# EasyEDA Pro project kuafu01_030内部老化方案_3.eprj (continued)
## Notes on the sheets (continued)
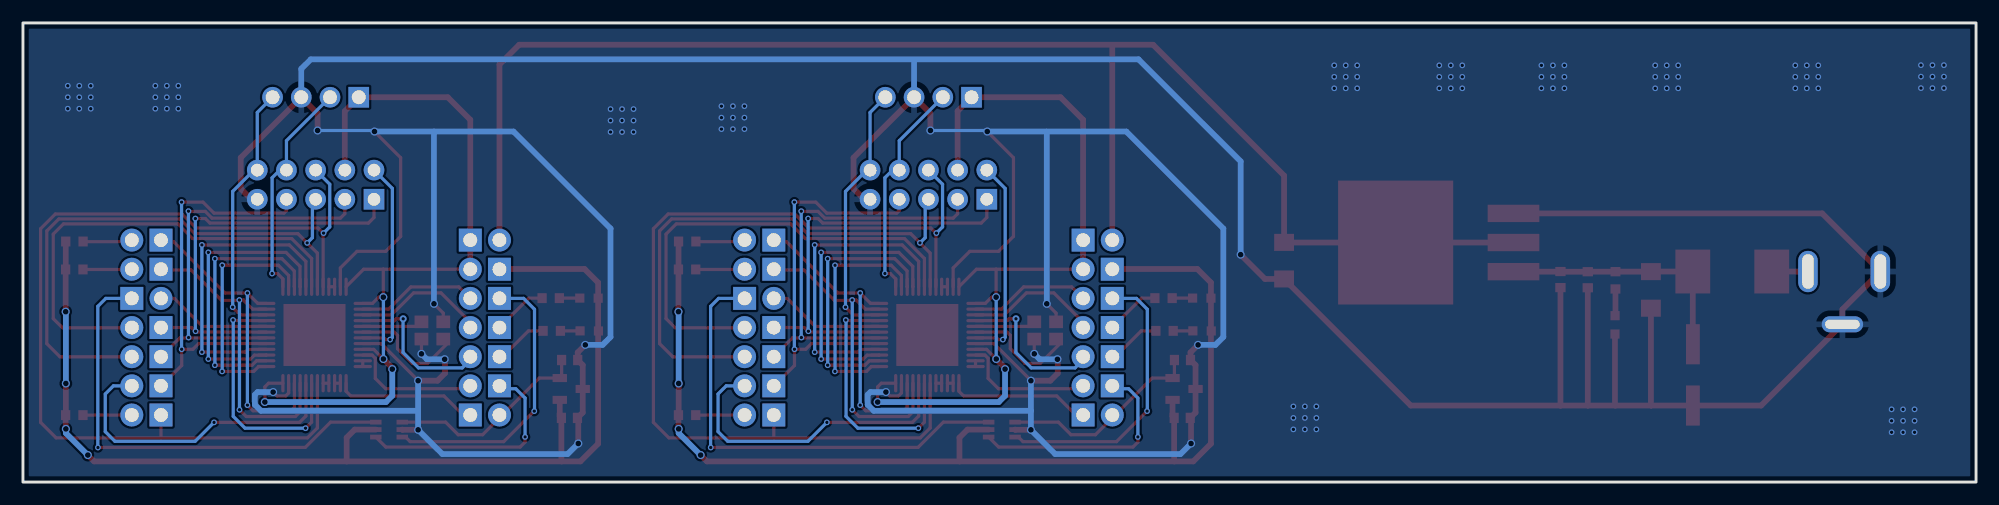
[diagram p3: board, bottom side, seen from below]

Outline 170 x 40 mm; copper layers: Top Layer, Bottom Layer. Coordinates in mm from the lower left corner of the outline.
Outline path: rectangle 0,40 170,0
Stack: Top Layer 0.035mm / Dielectric1 1.51mm FR4 er 4.5 / Bottom Layer 0.035mm

## Design rules (mm)
template: 用户自定义配置
spacing safeClearance (default): track to track 0.152, other pairs 0.152 to 0.3
track width trackWidth (default): min 0.127, default 0.254, max 2.54
differential pair differentialPair (default): width min 0.127, default 0.254, max 2.54; gap min 0.152, default 0.152
via viaSize (default): diameter min 0.5, default 0.61, max 10; hole min 0.3, default 0.305, max 6

## Placement (name value [footprint] x y rotation side)
C1  470nF  [C0603]  69.1 5.59 180 top
C1#2  -  [C0603]  122.44 5.59 180 top
C2  10uF  [C1206]  28.3 16.74 270 top
C3  10uF  [C1206]  60.23 19.29 90 top
C4  100uF  [CAP-SMD_BD6.3-L6.6-W6.6-LS7.6-FD-1]  24.64 9.34 270 top
C5  100nF  [C0603]  33.79 17.63 90 top
C6  100nF  [C0603]  69.07 10.63 0 top
C6#2  -  [C0603]  122.41 10.63 0 top
C7  100nF  [C0603]  36.17 17.64 90 top
CN1  DS254P-2X5-L0  [IDC-TH_10P-P2.54-V-R2-C5-S2.54]  91.19 25.91 0 top
CN1#2  -  [IDC-TH_10P-P2.54-V-R2-C5-S2.54]  144.53 25.91 0 top
CN2  XH-4A  [CONN-TH_4P-P2.50_XH-4A]  91.19 33.53 0 top
CN2#2  -  [CONN-TH_4P-P2.50_XH-4A]  144.53 33.53 0 top
D1  SS36-E3/57T  [SMC_L7.1-W6.2-LS8.1-R-RD]  21.22 18.34 180 top
DC1  HX DC005 QT  [DC-IN-TH_HANXIA_HX-DC005-QT]  11.48 16.04 0 top
H1  PZ254V-11-02P  [HDR-TH_2P-P2.54-V-M]  76.45 13.46 0 top
H1#2  -  [HDR-TH_2P-P2.54-V-M]  129.79 13.46 0 top
H2  PZ254V-11-02P  [HDR-TH_2P-P2.54-V-M]  76.45 10.92 0 top
H2#2  -  [HDR-TH_2P-P2.54-V-M]  129.79 10.92 0 top
H3  PZ254V-11-02P  [HDR-TH_2P-P2.54-V-M]  105.92 13.46 0 top
H3#2  -  [HDR-TH_2P-P2.54-V-M]  159.26 13.46 0 top
H4  PZ254V-11-02P  [HDR-TH_2P-P2.54-V-M]  105.92 10.92 0 top
H4#2  -  [HDR-TH_2P-P2.54-V-M]  159.26 10.92 0 top
H5  PZ254V-11-02P  [HDR-TH_2P-P2.54-V-M]  105.92 8.38 0 top
H5#2  -  [HDR-TH_2P-P2.54-V-M]  159.26 8.38 0 top
H6  PZ254V-11-02P  [HDR-TH_2P-P2.54-V-M]  105.92 16 180 top
H6#2  -  [HDR-TH_2P-P2.54-V-M]  159.26 16 180 top
H7  PZ254V-11-02P  [HDR-TH_2P-P2.54-V-M]  76.45 16 0 top
H7#2  -  [HDR-TH_2P-P2.54-V-M]  129.79 16 0 top
H8  PZ254V-11-02P  [HDR-TH_2P-P2.54-V-M]  76.45 8.38 0 top
H8#2  -  [HDR-TH_2P-P2.54-V-M]  129.79 8.38 0 top
H9  PZ254V-11-02P  [HDR-TH_2P-P2.54-V-M]  76.45 18.54 0 top
H9#2  -  [HDR-TH_2P-P2.54-V-M]  129.79 18.54 0 top
H10  PZ254V-11-02P  [HDR-TH_2P-P2.54-V-M]  76.45 21.08 180 top
H10#2  -  [HDR-TH_2P-P2.54-V-M]  129.79 21.08 180 top
H11  PZ254V-11-02P  [HDR-TH_2P-P2.54-V-M]  105.92 18.54 0 top
H11#2  -  [HDR-TH_2P-P2.54-V-M]  159.26 18.54 0 top
H12  PZ254V-11-02P  [HDR-TH_2P-P2.54-V-M]  105.92 21.08 0 top
H12#2  -  [HDR-TH_2P-P2.54-V-M]  159.26 21.08 0 top
H13  PZ254V-11-02P  [HDR-TH_2P-P2.54-V-M]  105.92 5.84 0 top
H13#2  -  [HDR-TH_2P-P2.54-V-M]  159.26 5.84 0 top
H14  PZ254V-11-02P  [HDR-TH_2P-P2.54-V-M]  76.45 5.84 180 top
H14#2  -  [HDR-TH_2P-P2.54-V-M]  129.79 5.84 180 top
LED1  NCD0603R1  [LED0603-RD_RED]  67.39 16.02 180 top
LED1#2  -  [LED0603-RD_RED]  120.73 16.02 180 top
LED2  19-217/GHC-YR1S2/3T  [LED0603-RD]  67.37 13.17 180 top
LED2#2  -  [LED0603-RD]  120.71 13.17 180 top
LED3  19-217/GHC-YR1S2/3T  [LED0603-RD]  31.42 13.7 90 top
R1  10K  [R0603]  70.72 16.02 180 top
R1#2  -  [R0603]  124.06 16.02 180 top
R2  10K  [R0603]  70.63 13.17 180 top
R2#2  -  [R0603]  123.97 13.17 180 top
R3  150Ω  [R0603]  112.19 5.83 0 top
R3#2  -  [R0603]  165.53 5.83 0 top
R4  0603WAF4701T5E/4.7KΩ  [R0603]  112.19 18.52 180 top
R4#2  -  [R0603]  165.53 18.52 180 top
R5  0603WAF4701T5E/4.7KΩ  [R0603]  112.18 20.96 0 top
R5#2  -  [R0603]  165.52 20.96 0 top
R6  10kΩ  [R0603]  31.38 17.58 90 top
U1  REF2920AIDBZR  [SOT-23-3_L2.9-W1.3-P1.90-LS2.4-BR]  68.94 8.11 0 top
U1#2  -  [SOT-23-3_L2.9-W1.3-P1.90-LS2.4-BR]  122.28 8.11 0 top
U2  BL1551B  [SC-70-6_L2.1-W1.3-P0.65-LS2.3-BR]  84.8 4.57 180 top
U2#2  -  [SC-70-6_L2.1-W1.3-P0.65-LS2.3-BR]  138.14 4.57 180 top
U6  PT32A030C8T7  [LQFP-48_L7.0-W7.0-P0.50-LS9.0-BL-EP5.4]  91.28 12.81 270 top
U6#2  -  [LQFP-48_L7.0-W7.0-P0.50-LS9.0-BL-EP5.4]  144.62 12.81 270 top
U7  AMS1086CM-5.0  [TO-263-3_L8.6-W10.2-P2.54-LS14.4-TL]  45.39 20.87 0 top
X1  25MHz  [OSC-SMD_4P-L2.5-W2.0-BL]  81.03 13.21 180 top
X1#2  -  [OSC-SMD_4P-L2.5-W2.0-BL]  134.37 13.21 180 top

## Footprints (pads in the part's own frame, mm; a bottom-side part is the same pattern mirrored in y, then rotated)
C0603
  rect 0.8x0.9 smd: 1(-0.7,0) 2(0.7,0)
C1206
  rect 1.485x1.728 smd: 1(-1.593,0) 2(1.593,0)
CAP-SMD_BD6.3-L6.6-W6.6-LS7.6-FD-1
  rect 3.5x1.2 smd: 1(-2.67,0) 2(2.67,0)
CONN-TH_4P-P2.50_XH-4A
  rect 1.8x1.8 hole 1.199: 1(-3.751,0)
  round 1.8 hole 1.199: 2(-1.25,0) 3(1.25,0) 4(3.751,0)
DC-IN-TH_HANXIA_HX-DC005-QT
  oval 3.6x1.4 hole 3x0.8: 2(0.15,-2.3)
  oval 1.7x3.6 hole 1x3: 3(-3.15,2.3) 4(3.15,2.3)
HDR-TH_2P-P2.54-V-M
  rect 2x2 hole 1.2: 1(-1.27,0)
  round 2 hole 1.2: 2(1.27,0)
IDC-TH_10P-P2.54-V-R2-C5-S2.54
  rect 1.8x1.8 hole 1.1: 1(-5.08,-1.27)
  round 1.8 hole 1.1: 2(-5.08,1.27) 3(-2.54,-1.27) 4(-2.54,1.27) 5(0,-1.27) 6(0,1.27) 7(2.54,-1.27) 8(2.54,1.27) 9(5.08,-1.27) 10(5.08,1.27)
LED0603-RD
  rect 0.8x0.8 smd: 1(-0.799,-0.004) 2(0.799,0.004)
LED0603-RD_RED
  rect 0.8x0.8 smd: 1(-0.799,-0.004) 2(0.799,0.004)
LQFP-48_L7.0-W7.0-P0.50-LS9.0-BL-EP5.4
  oval 0.28x1.6 smd: 1(-2.75,-4.2) 2(-2.25,-4.2) 3(-1.75,-4.2) 4(-1.25,-4.2) 5(-0.75,-4.2) 6(-0.25,-4.2) 7(0.25,-4.2) 8(0.75,-4.2) 9(1.25,-4.2) 10(1.75,-4.2) 11(2.25,-4.2) 12(2.75,-4.2) 25(2.75,4.2) 26(2.25,4.2) 27(1.75,4.2) 28(1.25,4.2) 29(0.75,4.2) 30(0.25,4.2) 31(-0.25,4.2) 32(-0.75,4.2) 33(-1.25,4.2) 34(-1.75,4.2) 35(-2.25,4.2) 36(-2.75,4.2)
  oval 1.6x0.28 smd: 13(4.2,-2.75) 14(4.2,-2.25) 15(4.2,-1.75) 16(4.2,-1.25) 17(4.2,-0.75) 18(4.2,-0.25) 19(4.2,0.25) 20(4.2,0.75) 21(4.2,1.25) 22(4.2,1.75) 23(4.2,2.25) 24(4.2,2.75) 37(-4.2,2.75) 38(-4.2,2.25) 39(-4.2,1.75) 40(-4.2,1.25) 41(-4.2,0.75) 42(-4.2,0.25) 43(-4.2,-0.25) 44(-4.2,-0.75) 45(-4.2,-1.25) 46(-4.2,-1.75) 47(-4.2,-2.25) 48(-4.2,-2.75)
  rect 5.4x5.4 smd: 49(0,0)
OSC-SMD_4P-L2.5-W2.0-BL
  rect 1.2x1.1 smd: 1(-0.95,-0.75) 2(0.95,-0.75) 3(0.95,0.75) 4(-0.95,0.75)
R0603
  rect 0.806x0.864 smd: 1(-0.753,0) 2(0.753,0)
SC-70-6_L2.1-W1.3-P0.65-LS2.3-BR
  rect 1x0.42 smd: 1(1.15,-0.65) 2(1.15,0) 3(1.15,0.65) 4(-1.15,0.65) 5(-1.15,0) 6(-1.15,-0.65)
SMC_L7.1-W6.2-LS8.1-R-RD
  rect 3.03x3.82 smd: 1(3.435,0) 2(-3.435,0)
SOT-23-3_L2.9-W1.3-P1.90-LS2.4-BR
  rect 1.25x0.7 smd: 1(1,-0.95) 2(1,0.95) 3(-1,0)
TO-263-3_L8.6-W10.2-P2.54-LS14.4-TL
  rect 4.5x1.511 smd: 1(-5.128,2.54) 2(-5.128,0) 3(-5.128,-2.54)
  rect 10.02x10.8 smd: 4(5.129,0)

## Nets
2.048V: C6.2 C6#2.2 H14.2 H14#2.2 U1.2 U1#2.2 U2.1 U2#2.1
6.5V: C2.1 C4.1 C5.2 C7.2 D1.2 R6.2 U7.3
GND: C1.2 C1#2.2 C2.2 C3.1 C4.2 C5.1 C6.1 C6#2.1 C7.1 CN1.9 CN1#2.9 CN2.3 CN2#2.3 DC1.2 DC1.3 LED3.1 U1.3 U1#2.3 U2.2 U2#2.2 U6.8 U6.23 U6.47 U6#2.8 U6#2.23 U6#2.47 U7.1 X1.2 X1.4 X1#2.2 X1#2.4
LDO_5V: C3.2 H10.2 H10#2.2 U7.2 U7.4
MCU_5V: CN1.4 CN1#2.4 CN2.1 CN2#2.1 H9.2 H9#2.2 H10.1 H10#2.1 U6.1 U6.9 U6.24 U6.48 U6#2.1 U6#2.9 U6#2.24 U6#2.48
PA0/OPA1_P/CMP1_P: H8.2 H8#2.2 U6.10 U6#2.10
PA1/OPA1_N: U6.11 U6.12 U6#2.11 U6#2.12
PA3/OPA0_P: H14.1 H14#2.1 U6.13 U6#2.13
PA4/OPA0_N: U6.14 U6.15 U6#2.14 U6#2.15
PA6/SET_ADC_ETR: U6.16 U6.17 U6#2.16 U6#2.17
PA8/TIM1_CH1/CMP2_OUT/TSTROBE: CN1.7 CN1#2.7 H5.1 H5#2.1 U6.29 U6#2.29
PA9/UART1_TX/CMP0_OUT/TDI: CN1.3 CN1#2.3 H4.1 H4#2.1 U6.30 U6#2.30
PA10/UART1_RX/CMP1_OUT/TDO: CN1.1 CN1#2.1 H3.1 H3#2.1 U6.31 U6#2.31
PA11/ENB1: H6.2 H6#2.2 U6.32 U6#2.32
PA12/TIM1_ETR: U6.19 U6.33 U6#2.19 U6#2.33
PA13/SWDIO/TAI: CN1.10 CN1#2.10 CN2.4 CN2#2.4 U6.34 U6#2.34
PA14/SWCLK/TAO: CN1.8 CN1#2.8 CN2.2 CN2#2.2 U6.37 U6#2.37
PA15/SPI1_CS: U6.25 U6.38 U6#2.25 U6#2.38
PB0/GET_BEEP: CN1.6 CN1#2.6 H13.1 H13#2.1 U6.18 U6.44 U6#2.18 U6#2.44
PB6/UART0_TX/GET_MCP1_OUT: H3.2 H3#2.2 U6.42 U6#2.42
PB7/UART0_RX/TCK: CN1.5 CN1#2.5 H4.2 H4#2.2 U6.43 U6#2.43
PB8/TIM6_CH1: U6.45 U6.46 U6#2.45 U6#2.46
PB10/I2C1_SCL/CMP0_P1: H11.1 H11#2.1 U6.21 U6.35 U6#2.21 U6#2.35
PB11/I2C1_SDA: H12.1 H12#2.1 U6.22 U6.36 U6#2.22 U6#2.36
PB13/SPI0_SCK: U6.26 U6.39 U6#2.26 U6#2.39
PB14/SPI0_MISO: U6.27 U6.40 U6#2.27 U6#2.40
PB15/SPI0_MOSI/SET_CMP2_P0: U6.28 U6.41 U6#2.28 U6#2.41
PC13/SET_CMP1_P: H7.2 H7#2.2 U6.2 U6#2.2
PC14/LED_RED: H1.2 H1#2.2 U6.3 U6#2.3
PC15/LED_GREEN: H2.2 H2#2.2 U6.4 U6#2.4
PERIPHERAL_5V: C1.1 C1#2.1 H9.1 H9#2.1 LED1.2 LED1#2.2 LED2.2 LED2#2.2 R3.2 R3#2.2 R4.1 R4#2.1 R5.2 R5#2.2 U1.1 U1#2.1 U2.5 U2#2.5
PF0/OSC_IN: U6.5 U6#2.5 X1.1 X1#2.1
PF1/OSC_OUT: U6.6 U6#2.6 X1.3 X1#2.3
PF2/TIM5_CH1/GET_CMP2_OUT: H5.2 H5#2.2 U6.20 U6#2.20
RSTN: CN1.2 CN1#2.2 U6.7 U6#2.7
$3N9153: D1.1 DC1.4
$3N9301: LED3.2 R6.1
$4N6329: LED2.1 LED2#2.1 R2.2 R2#2.2
$4N6330: LED1.1 LED1#2.1 R1.2 R1#2.2
$4N10186: H7.1 H7#2.1 U2.3 U2#2.3
$4N10193: H6.1 H6#2.1 U2.6 U2#2.6
$4N10258: H2.1 H2#2.1 R2.1 R2#2.1
$4N10262: H1.1 H1#2.1 R1.1 R1#2.1
$4N16114: H8.1 H8#2.1 U2.4 U2#2.4
$4N17047: H11.2 H11#2.2 R4.2 R4#2.2
$4N17074: H12.2 H12#2.2 R5.1 R5#2.1
$4N17158: H13.2 H13#2.2 R3.1 R3#2.1

Pads without a net: U6 49; U6#2 49

## Via types
v1: diameter 0.5, hole 0.3, Top Layer to Bottom Layer, 166 vias
v2: diameter 0.7, hole 0.5, Top Layer to Bottom Layer, 37 vias
v3: diameter 0.61, hole 0.305, Top Layer to Bottom Layer, 2 vias

## Routing (per net, layer and track width the routed paths; a pad name or vN(x,y) marks a point on that pad's centre or on a via; arc(x,y) is an arc through that point)
2.048V: length 35.7
  Top Layer w0.28: C6#2.2 123.11,9.22 U1#2.2 125.05,9.06 129.99,4.12 132.12,4.12 133.22,5.22 U2#2.1 ; U2.1 79.88,5.22 78.78,4.12 76.65,4.12 71.71,9.06 U1.2 69.77,9.22 C6.2
6.5V: length 22
  Top Layer w0.5: U7.3 36.19,18.33 C7.2 36.15,18.33 C5.2 33.79,18.33 R6.2 31.38,18.33 C2.1 28.29,18.34 D1.2 24.65,12.02 C4.1
GND: length 544.7
  Top Layer w0.28: v2(80.89,15.53) 80.08,14.72 X1.2 ; X1#2.2 133.42,14.72 v2(134.23,15.53) ; U6#2.47 142.38,18.65 140.93,20.1 138.43,20.1 137.13,21.4 137.13,28.26 v2(139.41,30.54) ; U6.47 89.03,18.65 87.59,20.1 85.09,20.1 83.79,21.4 83.79,28.26 v2(86.07,30.54) ; 87.09,12.06 85.48,12.06 82.27,8.85 v2(82.27,8.83) ; U6#2.23 146.87,7.76 147.14,7.5 147.89,7.5 v2(148.23,7.84) ; v2(94.89,7.84) 94.55,7.5 93.8,7.5 93.53,7.76 U6.23 ; X1#2.4 v2(135.32,11.17) ; 140.43,12.06 138.82,12.06 135.61,8.85 v2(135.61,8.83) ; X1.4 v2(81.98,11.17)
  Top Layer w0.5: C5.1 33.79,6.68 33.78,6.67 ; v2(67.72,11.95) 68.37,11.29 C6.1 67.94,10.19 U1.3 67.94,6.05 C1.2 68.33,5.52 v2(68.33,3.36) ; U7.1 13.39,23.41 8.33,18.34 11.63,15.04 DC1.2 18.71,6.67 C4.2 28.28,6.67 ; LED3.1 31.43,6.7 31.4,6.67 ; C7.1 36.17,6.67 36.17,6.67 ; CN1.9 96.78,24.64 97.71,25.56 97.71,28.26 CN2.3 91.02,32.11 v2(91.02,30.63) ; v2(135.61,4.55) 136.97,4.55 U2#2.2 ; v2(82.27,8.83) 80.58,8.83 79.93,9.48 79.93,10.67 v2(79.96,10.7) ; 28.28,6.67 28.3,6.68 C2.2 ; 28.28,6.67 31.4,6.67 ; 36.17,6.67 49.2,6.67 C3.1 61.89,17.7 v2(64.01,19.81) ; 36.17,6.67 33.78,6.67 ; v2(133.3,10.7) 133.27,10.67 133.27,9.48 133.92,8.83 v2(135.61,8.83) ; 31.4,6.67 33.78,6.67 ; v2(82.27,4.55) 83.63,4.55 U2.2 ; v2(121.06,11.95) 121.71,11.29 C6#2.1 121.28,10.19 U1#2.3 121.28,6.05 C1#2.2 121.67,5.52 v2(121.67,3.36) ; v2(144.36,30.63) 144.36,32.11 CN2#2.3 151.05,28.26 151.05,25.56 150.12,24.64 CN1#2.9
  Bottom Layer w0.28: v2(139.41,30.54) 139.5,30.63 v2(144.36,30.63) ; v2(91.02,30.63) 86.16,30.63 v2(86.07,30.54)
  Bottom Layer w0.5: v2(135.61,8.83) 135.61,6.21 ; 135.61,6.21 149.28,6.21 149.81,6.74 149.81,7.6 149.58,7.84 v2(148.23,7.84) ; 135.61,6.21 v2(135.61,4.55) 133.5,2.44 122.59,2.44 v2(121.67,3.36) ; 82.27,6.21 95.94,6.21 96.47,6.74 96.47,7.6 96.24,7.84 v2(94.89,7.84) ; 82.27,6.21 v2(82.27,4.55) 80.16,2.44 69.25,2.44 v2(68.33,3.36) ; 82.27,6.21 v2(82.27,8.83) ; v2(64.01,19.81) 64.01,27.94 72.9,36.83 144.95,36.83 145.78,36 CN2#2.3 ; CN2.3 92.44,36.78 ; v2(80.89,15.53) 80.89,30.54 ; v2(81.98,11.17) 81.51,10.7 v2(79.96,10.7) ; v2(67.72,11.95) 66.21,11.95 65.52,12.64 65.52,22.09 73.97,30.54 v2(86.07,30.54) ; v2(121.06,11.95) 119.55,11.95 118.86,12.64 118.86,22.09 127.31,30.54 v2(139.41,30.54) ; v2(135.32,11.17) 134.85,10.7 v2(133.3,10.7) ; v2(134.23,15.53) 134.23,30.54
  vias: v1(2.79,36.32) v1(2.79,35.32) v1(2.79,34.32) v1(3.79,36.32) v1(3.79,35.32) v1(3.79,34.32) v1(4.79,36.32) v1(4.79,35.32) v1(4.79,34.32) v1(5.35,6.33) v1(5.35,5.33) v1(5.35,4.33) v1(6.35,6.33) v1(6.35,5.33) v1(6.35,4.33) v1(7.35,6.33) v1(7.35,5.33) v1(7.35,4.33) v1(13.73,36.31) v1(13.73,35.31) v1(13.73,34.31) v1(14.73,36.31) v1(14.73,35.31) v1(14.73,34.31) v1(15.73,36.31) v1(15.73,35.31) v1(15.73,34.31) v1(25.92,36.31) v1(25.92,35.31) v1(25.92,34.31) v1(26.92,36.31) v1(26.92,35.31) v1(26.92,34.31) v1(27.92,36.31) v1(27.92,35.31) v1(27.92,34.31) v1(35.83,36.31) v1(35.83,35.31) v1(35.83,34.31) v1(36.83,36.31) v1(36.83,35.31) v1(36.83,34.31) v1(37.83,36.31) v1(37.83,35.31) v1(37.83,34.31) v1(44.72,36.31) v1(44.72,35.31) v1(44.72,34.31) v1(45.72,36.31) v1(45.72,35.31) v1(45.72,34.31) v1(46.72,36.31) v1(46.72,35.31) v1(46.72,34.31) v1(53.86,36.31) v1(53.86,35.31) v1(53.86,34.31) v1(54.86,36.31) v1(54.86,35.31) v1(54.86,34.31) v1(55.86,36.31) v1(55.86,35.31) v1(55.86,34.31) v1(57.42,6.59) v1(57.42,5.59) v1(57.42,4.59) v1(58.42,6.59) v1(58.42,5.59) v1(58.42,4.59) v1(59.42,6.59) v1(59.42,5.59) v1(59.42,4.59) v1(107.2,32.75) v1(107.2,31.75) v1(107.2,30.75) v1(108.2,32.75) v1(108.2,31.75) v1(108.2,30.75) v1(109.2,32.75) v1(109.2,31.75) v1(109.2,30.75) v1(116.86,32.5) v1(116.86,31.5) v1(116.86,30.5) v1(117.86,32.5) v1(117.86,31.5) v1(117.86,30.5) v1(118.86,32.5) v1(118.86,31.5) v1(118.86,30.5) v1(156.48,34.53) v1(156.48,33.53) v1(156.48,32.53) v1(157.48,34.53) v1(157.48,33.53) v1(157.48,32.53) v1(158.48,34.53) v1(158.48,33.53) v1(158.48,32.53) v1(164.1,34.53) v1(164.1,33.53) v1(164.1,32.53) v1(165.1,34.53) v1(165.1,33.53) v1(165.1,32.53) v1(166.1,34.53) v1(166.1,33.53) v1(166.1,32.53)
LDO_5V: length 131.7
  Top Layer w0.5: H10.2 75.18,37.92 ; H10#2.2 128.52,36.38 126.81,38.1 71.63,38.1 60.23,26.7 C3.2 60.22,20.87 U7.4 U7.2
MCU_5V: length 143.4
  Top Layer w0.28: 138.63,18.54 138.64,18.54 v2(138.64,16.11) 139.03,16.11 139.58,15.56 140.43,15.56 ; 138.63,18.54 H9#2.2 ; 138.63,18.54 140.35,18.54 U6#2.48 ; U6.24 95.28,8.61 95.61,8.29 v2(95.61,6.97) ; 87.09,15.56 86.24,15.56 85.69,16.11 v2(85.3,16.11) 85.3,18.54 85.29,18.54 ; U6.48 87.01,18.54 85.29,18.54 ; v2(85.29,10.72) 86.13,11.56 87.09,11.56 ; v2(148.95,6.97) 148.95,8.29 148.62,8.61 U6#2.24 ; 85.29,18.54 H9.2 ; 140.43,11.56 139.47,11.56 v2(138.63,10.72)
  Top Layer w0.5: CN1#2.4 141.99,32.32 CN2#2.1 133.03,33.53 131.06,31.57 H10#2.1 H9#2.2 ; H9.2 H10.1 77.72,31.57 79.69,33.53 CN2.1 88.65,32.32 CN1.4 ; v2(84.52,9.84) 84.52,9.95 v2(85.29,10.72) ; v2(138.63,10.72) 137.86,9.95 v2(137.86,9.84)
  Bottom Layer w0.28: v2(85.29,10.72) 85.29,16.1 v2(85.3,16.11) ; v2(138.64,16.11) 138.63,16.1 v2(138.63,10.72)
  Bottom Layer w0.5: v2(148.95,6.97) 138.41,6.97 137.86,7.52 v2(137.86,9.84) ; v2(84.52,9.84) 84.52,7.52 85.07,6.97 v2(95.61,6.97)
PA0/OPA1_P/CMP1_P: length 23.2
  Top Layer w0.28: 131.06,8.13 138.43,8.13 139.33,9.03 139.33,10.78 139.61,11.06 140.43,11.06 ; 87.09,11.06 86.27,11.06 85.99,10.78 85.99,9.03 85.09,8.13 77.72,8.13
PA1/OPA1_N: length 1
  Top Layer w0.28: 140.43,10.56 140.43,10.06 ; 87.09,10.56 87.09,10.06
PA3/OPA0_P: length 25
  Top Layer w0.28: U6.13 88.53,7.91 88.13,7.5 80.02,7.5 78.1,5.59 77.72,5.59 ; 131.06,5.59 131.44,5.59 133.36,7.5 141.47,7.5 141.87,7.91 U6#2.13
PA4/OPA0_N: length 1
  Top Layer w0.28: U6.14 U6.15 ; U6#2.14 U6#2.15
PA6/SET_ADC_ETR: length 1
  Top Layer w0.28: U6#2.16 U6#2.17 ; U6.16 U6.17
PA8/TIM1_CH1/CMP2_OUT/TSTROBE: length 69.9
  Top Layer w0.28: v1(156.2,24.39) 154.33,24.39 153.37,23.43 147.28,23.43 147.07,23.65 CN1#2.7 ; v1(102.86,24.39) 100.99,24.39 100.03,23.43 93.94,23.43 93.73,23.65 CN1.7 ; H5#2.1 157.96,8.38 156.19,10.15 v1(156.19,11.57) 155.21,11.57 154.71,12.07 148.83,12.07 U6#2.29 ; U6.29 95.49,12.07 101.37,12.07 101.87,11.57 v1(102.85,11.57) 102.85,10.15 104.62,8.38 H5.1
  Bottom Layer w0.28: v1(102.85,11.57) 102.86,11.58 v1(102.86,24.39) ; v1(156.2,24.39) 156.2,11.58 v1(156.19,11.57)
PA9/UART1_TX/CMP0_OUT/TDI: length 72.3
  Top Layer w0.28: U6.30 103.01,12.56 H4.1 ; CN1#2.3 141.99,23.38 142.37,22.99 153.55,22.99 154.14,23.58 155.58,23.58 v1(155.6,23.6) ; H4#2.1 156.35,12.56 U6#2.30 ; CN1.3 88.65,23.38 89.03,22.99 100.21,22.99 100.8,23.58 102.24,23.58 v1(102.26,23.6)
  Bottom Layer w0.28: v1(102.26,23.6) 102.26,12.6 v1(102.25,12.59) ; v1(155.59,12.59) 155.6,12.6 v1(155.6,23.6)
PA10/UART1_RX/CMP1_OUT/TDO: length 73.3
  Top Layer w0.28: CN1.1 86.11,23.05 86.59,22.56 100.39,22.56 100.79,22.96 v1(101.66,22.96) ; CN1#2.1 139.45,23.05 139.93,22.56 153.73,22.56 154.13,22.96 v1(155,22.96) ; U6.31 101.6,13.06 102,13.46 H3.1 ; H3#2.1 155.34,13.46 154.94,13.06 U6#2.31
  Bottom Layer w0.28: v1(101.66,22.96) 101.66,13.16 v1(101.64,13.14) ; v1(155,22.96) 155,13.16 v1(154.98,13.14)
PA11/ENB1: length 20.3
  Top Layer w0.28: H6.2 103.49,16 101.05,13.56 U6.32 ; H6#2.2 156.83,16 154.39,13.56 U6#2.32
PA12/TIM1_ETR: length 44.4
  Top Layer w0.28: 91.54,8.61 91.54,5.22 v1(92.07,4.69) ; 144.88,8.61 144.88,5.22 v1(145.41,4.69) ; v1(151.72,14.12) 151.66,14.06 U6#2.33 ; U6.33 98.32,14.06 v1(98.38,14.12)
  Bottom Layer w0.28: v1(92.07,4.69) 97.33,4.69 98.36,5.72 98.36,14.1 v1(98.38,14.12) ; v1(145.41,4.69) 150.67,4.69 151.7,5.72 151.7,14.1 v1(151.72,14.12)
PA13/SWDIO/TAI: length 46.4
  Top Layer w0.28: v1(151.75,15.24) 151.75,15.23 151.08,14.56 U6#2.34 ; v1(98.41,15.24) 98.41,15.23 97.74,14.56 U6.34
  Bottom Layer w0.28: CN2.4 96.27,32.2 CN1.10 96.41,27.32 98.41,25.32 v1(98.41,15.24) ; CN2#2.4 149.61,32.2 CN1#2.10 149.75,27.32 151.75,25.32 v1(151.75,15.24)
PA14/SWCLK/TAO: length 39.2
  Top Layer w0.28: v1(94.98,18.17) 94.51,18.17 94.03,17.7 U6.37 ; U6#2.37 147.37,17.7 147.85,18.17 v1(148.32,18.17)
  Bottom Layer w0.28: v1(94.98,18.17) 94.98,26.51 94.31,27.18 CN1.8 93.73,29.74 CN2.2 ; v1(148.32,18.17) 148.32,26.51 147.65,27.18 CN1#2.8 147.07,29.74 CN2#2.2
PA15/SPI1_CS: length 40.8
  Top Layer w0.28: 146.88,17.02 146.88,18 147.77,18.89 v1(152.66,18.89) ; U6#2.25 149.49,10.06 149.92,9.64 v1(152.67,9.64) ; v1(99.32,18.89) 94.43,18.89 93.54,18 93.54,17.02 ; v1(99.33,9.64) 96.58,9.64 96.15,10.06 U6.25
  Bottom Layer w0.28: v1(152.66,18.89) 152.66,9.65 v1(152.67,9.64) ; v1(99.33,9.64) 99.32,9.65 v1(99.32,18.89)
PB0/GET_BEEP: length 169.1
  Top Layer w0.28: 104.63,3.85 91.9,3.85 91.03,4.71 U6.18 ; 104.63,3.85 104.65,3.86 H13.1 ; 104.63,3.85 113.78,3.85 115.13,5.2 115.13,22.07 113.84,23.36 102.82,23.36 101.59,22.13 90.98,22.13 90.53,21.69 ; 143.87,21.69 144.32,22.13 154.93,22.13 156.16,23.36 167.18,23.36 168.47,22.07 168.47,5.2 167.12,3.85 157.97,3.85 ; 143.87,21.69 143.83,21.69 ; 143.87,21.69 U6#2.44 ; 90.53,21.69 U6.44 ; 90.53,21.69 90.49,21.69 ; 157.97,3.85 157.99,3.86 H13#2.1 ; 157.97,3.85 145.24,3.85 144.38,4.71 U6#2.18
  Bottom Layer w0.28: CN1#2.6 143.3,25.95 143.3,22.23 v1(143.84,21.69) ; v1(90.5,21.69) 89.96,22.23 89.96,25.95 CN1.6
PB6/UART0_TX/GET_MCP1_OUT: length 82.2
  Top Layer w0.28: H3.2 107.21,13.44 113.23,13.44 114.03,14.24 114.03,21.6 113.13,22.49 103.18,22.49 101.89,21.21 93.27,21.21 91.53,19.48 U6.42 ; H3#2.2 160.55,13.44 166.57,13.44 167.37,14.24 167.37,21.6 166.47,22.49 156.52,22.49 155.23,21.21 146.61,21.21 144.87,19.48 U6#2.42
PB7/UART0_RX/TCK: length 99.9
  Top Layer w0.28: U6#2.43 144.38,19.95 v1(145.26,20.84) 146.07,21.64 155.06,21.64 156.34,22.92 166.88,22.92 167.93,21.88 167.93,12.06 166.78,10.91 160.54,10.91 H4#2.2 ; H4.2 107.2,10.91 113.44,10.91 114.59,12.06 114.59,21.88 113.54,22.92 103,22.92 101.72,21.64 92.73,21.64 v1(91.92,20.84) 91.03,19.95 U6.43
  Bottom Layer w0.28: v1(91.92,20.84) 91.47,21.29 91.47,24.36 CN1.5 ; v1(145.26,20.84) 144.81,21.29 144.81,24.36 CN1#2.5
PB8/TIM6_CH1: length 1
  Top Layer w0.28: U6.45 U6.46 ; U6#2.45 U6#2.46
PB10/I2C1_SCL/CMP0_P1: length 56.7
  Top Layer w0.28: U6.35 96.67,15.06 97.47,15.86 v1(97.83,15.86) 97.85,15.83 99.38,15.83 102.03,18.48 104.59,18.48 104.63,18.52 ; U6.21 92.53,6.12 92.95,5.71 97.23,5.71 v1(97.82,6.3) ; U6#2.21 145.87,6.12 146.29,5.71 150.57,5.71 v1(151.16,6.3) ; U6#2.35 150.01,15.06 150.81,15.86 v1(151.17,15.86) 151.19,15.83 152.72,15.83 155.37,18.48 157.93,18.48 157.97,18.52
  Bottom Layer w0.28: v1(151.16,6.3) 151.16,15.85 v1(151.17,15.86) ; v1(97.83,15.86) 97.82,15.85 v1(97.82,6.3)
PB11/I2C1_SDA: length 55.3
  Top Layer w0.28: U6.36 96.22,15.56 v1(97.13,16.47) 99.07,16.47 103.55,20.95 104.63,20.95 ; U6#2.36 149.56,15.56 v1(150.47,16.47) 152.41,16.47 156.89,20.95 157.97,20.95 ; v1(97.13,6.7) 96.64,6.21 93.33,6.21 93.03,6.5 U6.22 ; U6#2.22 146.38,6.5 146.67,6.21 149.98,6.21 v1(150.47,6.7)
  Bottom Layer w0.28: v1(150.47,6.7) v1(150.47,16.47) ; v1(97.13,6.7) v1(97.13,16.47)
PB13/SPI0_SCK: length 45.3
  Top Layer w0.28: U6.26 96.33,10.56 96.71,10.18 99.95,10.18 v1(99.96,10.18) ; U6#2.26 149.67,10.56 150.05,10.18 153.29,10.18 v1(153.3,10.18) ; U6#2.39 146.39,17.03 146.39,18.39 147.46,19.46 v1(153.3,19.46) ; U6.39 93.05,17.03 93.05,18.39 94.12,19.46 v1(99.96,19.46)
  Bottom Layer w0.28: v1(153.3,10.18) v1(153.3,19.46) ; v1(99.96,10.18) v1(99.96,19.46)
PB14/SPI0_MISO: length 49.5
  Top Layer w0.28: U6.40 92.55,17.03 92.55,18.79 93.77,20.01 v1(100.53,20.01) ; U6.27 95.49,11.06 96.52,11.06 96.85,10.72 100.52,10.72 v1(100.53,10.72) ; U6#2.27 148.83,11.06 149.86,11.06 150.19,10.72 153.86,10.72 v1(153.87,10.72) ; U6#2.40 145.89,17.03 145.89,18.79 147.11,20.01 v1(153.87,20.01)
  Bottom Layer w0.28: v1(153.87,10.72) v1(153.87,20.01) ; v1(100.53,10.72) v1(100.53,20.01)
PB15/SPI0_MOSI/SET_CMP2_P0: length 53.8
  Top Layer w0.28: v1(101.09,11.32) 97.34,11.32 97.1,11.56 U6.28 ; v1(154.43,20.66) 146.82,20.66 145.38,19.22 145.38,17.02 ; v1(101.09,20.66) 93.48,20.66 92.04,19.22 92.04,17.02 ; U6#2.28 150.44,11.56 150.68,11.32 v1(154.43,11.32)
  Bottom Layer w0.28: v1(101.09,20.66) v1(101.09,11.32) ; v1(154.43,20.66) v1(154.43,11.32)
PC13/SET_CMP1_P: length 21.2
  Top Layer w0.28: 87.09,15.06 84.84,15.06 82.9,17 78.72,17 H7.2 ; 140.43,15.06 138.18,15.06 136.24,17 132.06,17 H7#2.2
PC14/LED_RED: length 23.4
  Top Layer w0.28: H1.2 77.72,13.93 80.27,16.48 82.66,16.48 84.58,14.56 87.09,14.56 ; H1#2.2 131.06,13.93 133.61,16.48 136,16.48 137.92,14.56 140.43,14.56
PC15/LED_GREEN: length 26.4
  Top Layer w0.28: v3(83.57,14.22) 84.17,14.22 84.33,14.06 87.09,14.06 ; 140.43,14.06 137.67,14.06 137.51,14.22 v3(136.91,14.22)
  Bottom Layer w0.28: v3(83.57,14.22) 83.58,14.21 83.58,11.29 82.23,9.95 78.42,9.95 77.73,10.64 ; v3(136.91,14.22) 136.92,14.21 136.92,11.29 135.57,9.95 131.76,9.95 131.07,10.64
PERIPHERAL_5V: length 196.4
  Top Layer w0.5: v2(112.95,14.84) R4.1 112.94,18.53 R5.2 ; U2#2.5 141.13,4.57 141.83,3.87 141.83,1.82 141.81,1.8 ; v2(166.27,8.59) 166.27,5.85 R3#2.2 166.29,4.65 v2(166.27,4.63) ; v2(164.36,2.35) 163.81,1.8 141.81,1.8 ; v2(166.29,14.84) R4#2.1 166.28,18.53 R5#2.2 ; 69.78,1.8 69.8,1.82 C1.1 69.94,5.73 U1.1 ; 69.78,1.8 68.14,1.8 66.6,3.34 66.6,13.14 LED2.2 66.59,13.19 LED1.2 66.59,17.38 67.78,18.56 75.17,18.56 H9.1 ; 69.78,1.8 88.47,1.8 ; U2.5 87.79,4.57 88.49,3.87 88.49,1.82 88.47,1.8 ; 141.81,1.8 123.12,1.8 ; U1#2.1 123.28,5.73 C1#2.1 123.14,1.82 123.12,1.8 ; 88.47,1.8 110.47,1.8 v2(111.02,2.35) ; H9#2.1 128.51,18.56 121.12,18.56 119.93,17.38 LED1#2.2 119.93,13.19 LED2#2.2 119.94,13.14 119.94,3.34 121.48,1.8 123.12,1.8 ; v2(112.93,4.63) 112.95,4.65 R3.2 112.93,5.85 v2(112.93,8.59)
  Bottom Layer w0.5: v2(112.95,14.84) 112.93,14.82 v2(112.93,8.59) ; v2(166.27,8.59) 166.27,14.82 v2(166.29,14.84) ; v2(166.27,4.63) 166.27,4.26 v2(164.36,2.35) ; v2(111.02,2.35) 112.93,4.26 v2(112.93,4.63)
PF0/OSC_IN: length 10.5
  Top Layer w0.28: 140.43,13.56 135.71,13.56 X1#2.1 ; 87.09,13.56 82.37,13.56 X1.1
PF1/OSC_OUT: length 19.9
  Top Layer w0.28: 140.43,13.06 137.68,13.06 137.4,12.78 137.4,11.61 136.11,10.33 134.8,10.33 133.05,12.09 ; 79.71,12.09 81.46,10.33 82.77,10.33 84.06,11.61 84.06,12.78 84.34,13.06 87.09,13.06
PF2/TIM5_CH1/GET_CMP2_OUT: length 54.9
  Top Layer w0.28: U6#2.20 145.38,5.75 145.93,5.2 v1(153.37,5.2) ; v1(100.03,5.2) 92.59,5.2 92.03,5.75 U6.20
  Bottom Layer w0.28: v1(100.03,5.2) 101.68,3.55 108.66,3.55 109.5,4.39 109.5,7.67 108.79,8.38 H5.2 ; v1(153.37,5.2) 155.02,3.55 162,3.55 162.84,4.39 162.84,7.67 162.13,8.38 H5#2.2
RSTN: length 35.9
  Top Layer w0.28: v1(84.71,12.41) 85.1,12.41 85.26,12.56 87.09,12.56 ; v1(138.05,12.41) 138.44,12.41 138.6,12.56 140.43,12.56
  Bottom Layer w0.28: v1(84.71,12.41) 84.51,12.61 84.51,25.58 86.1,27.18 CN1.2 ; v1(138.05,12.41) 137.85,12.61 137.85,25.58 139.44,27.18 CN1#2.2
$3N9153: length 3.2
  Top Layer w0.5: DC1.4 17.78,18.34
$3N9301: length 2.3
  Top Layer w0.5: LED3.2 31.38,14.53 R6.1
$4N6329: length 3.4
  Top Layer w0.28: LED2.1 69.88,13.17 ; LED2#2.1 123.22,13.17
$4N6330: length 3.6
  Top Layer w0.28: LED1#2.1 123.31,16.03 R1#2.2 ; R1.2 69.97,16.03 68.19,16.03
$4N10186: length 50.2
  Top Layer w0.28: U2.3 83.36,3.92 82.96,3.52 74.82,3.52 v1(72.16,6.18) ; U2#2.3 136.7,3.92 136.3,3.52 128.16,3.52 v1(125.5,6.18)
  Bottom Layer w0.28: H7.1 73.08,16 72.13,15.05 72.13,6.2 v1(72.16,6.18) ; H7#2.1 126.42,16 125.47,15.05 125.47,6.2 v1(125.5,6.18)
$4N10193: length 81.3
  Top Layer w0.28: U2.6 89.89,5.22 92.09,3.02 110.13,3.02 v1(110.14,3.01) ; v1(163.48,3.01) 163.47,3.02 145.43,3.02 143.23,5.22 U2#2.6
  Bottom Layer w0.28: v1(110.14,3.01) 110.15,3.02 110.15,15.3 109.45,16 H6.1 ; v1(163.48,3.01) 163.49,3.02 163.49,15.3 162.79,16 H6#2.1
$4N10258: length 9.7
  Top Layer w0.28: R2#2.1 126,13.17 128.53,10.64 ; 75.19,10.64 72.66,13.17 R2.1
$4N10262: length 9.5
  Top Layer w0.28: R1#2.1 125.96,16.02 H1#2.1 ; R1.1 72.62,16.02 H1.1
$4N16114: length 39.9
  Top Layer w0.28: U2.4 85.08,3.05 73.39,3.05 72.96,3.48 v1(72.96,3.93) ; U2#2.4 138.42,3.05 126.73,3.05 126.3,3.48 v1(126.3,3.93)
  Bottom Layer w0.28: v1(126.3,3.93) 126.3,7.32 127.1,8.13 128.52,8.13 ; 75.18,8.13 73.76,8.13 72.96,7.32 v1(72.96,3.93)
$4N17047: length 8.5
  Top Layer w0.28: 164.78,18.52 160.51,18.52 ; 111.44,18.52 107.17,18.52
$4N17074: length 8.5
  Top Layer w0.28: R5.1 111.42,20.95 107.17,20.95 ; 160.51,20.95 164.76,20.95 R5#2.1
$4N17158: length 8.5
  Top Layer w0.28: H13.2 107.2,5.83 R3.1 ; H13#2.2 160.54,5.83 R3#2.1

## Copper pours and planes (outline as drawn; the poured copper is in the pictures)
GND on Top Layer: 0,40 170,40 170,0 0,0
GND on Bottom Layer: 0,40 170,40 170,0 0,0
